# EAGLE schematic Resistor_Resistor (EAGLE 8.3.0), part 5 of 43 (continued)
## Parts (continued)
R6592  10K  RESISTOR_0201  [0201]
R6593  10K  RESISTOR_0201  [0201]
R6594  10K  RESISTOR_0201  [0201]
R6595  10K  RESISTOR_0201  [0201]
R6596  10K  RESISTOR_0201  [0201]
R6597  10K  RESISTOR_0201  [0201]
R6598  10K  RESISTOR_0201  [0201]
R6599  10K  RESISTOR_0201  [0201]
R6600  10K  RESISTOR_0201  [0201]
R6601  10K  RESISTOR_0201  [0201]
R6602  10K  RESISTOR_0201  [0201]
R6603  10K  RESISTOR_0201  [0201]
R6604  10K  RESISTOR_0201  [0201]
R6605  10K  RESISTOR_0201  [0201]
R6606  10K  RESISTOR_0201  [0201]
R6607  10K  RESISTOR_0201  [0201]
R6608  10K  RESISTOR_0201  [0201]
R6609  10K  RESISTOR_0201  [0201]
R6610  10K  RESISTOR_0201  [0201]
R6611  10K  RESISTOR_0201  [0201]
R6612  10K  RESISTOR_0201  [0201]
R6613  10K  RESISTOR_0201  [0201]
R6614  10K  RESISTOR_0201  [0201]
R6615  10K  RESISTOR_0201  [0201]
R6616  10K  RESISTOR_0201  [0201]
R6617  10K  RESISTOR_0201  [0201]
R6618  10K  RESISTOR_0201  [0201]
R6619  10K  RESISTOR_0201  [0201]
R6620  10K  RESISTOR_0201  [0201]
R6621  10K  RESISTOR_0201  [0201]
R6622  10K  RESISTOR_0201  [0201]
R6623  10K  RESISTOR_0201  [0201]
R6624  10K  RESISTOR_0201  [0201]
R6625  10K  RESISTOR_0201  [0201]
R6626  10K  RESISTOR_0201  [0201]
R6627  10K  RESISTOR_0201  [0201]
R6628  10K  RESISTOR_0201  [0201]
R6629  10K  RESISTOR_0201  [0201]
R6630  10K  RESISTOR_0201  [0201]
R6631  10K  RESISTOR_0201  [0201]
R6632  10K  RESISTOR_0201  [0201]
R6633  10K  RESISTOR_0201  [0201]
R6634  10K  RESISTOR_0201  [0201]
R6635  10K  RESISTOR_0201  [0201]
R6636  10K  RESISTOR_0201  [0201]
R6637  10K  RESISTOR_0201  [0201]
R6638  10K  RESISTOR_0201  [0201]
R6639  10K  RESISTOR_0201  [0201]
R6640  10K  RESISTOR_0201  [0201]
R6641  10K  RESISTOR_0201  [0201]
R6642  10K  RESISTOR_0201  [0201]
R6643  10K  RESISTOR_0201  [0201]
R6644  10K  RESISTOR_0201  [0201]
R6645  10K  RESISTOR_0201  [0201]
R6646  10K  RESISTOR_0201  [0201]
R6647  10K  RESISTOR_0201  [0201]
R6648  10K  RESISTOR_0201  [0201]
R6649  10K  RESISTOR_0201  [0201]
R6650  10K  RESISTOR_0201  [0201]
R6651  10K  RESISTOR_0201  [0201]
R6652  10K  RESISTOR_0201  [0201]
R6653  10K  RESISTOR_0201  [0201]
R6654  10K  RESISTOR_0201  [0201]
R6655  10K  RESISTOR_0201  [0201]
R6656  10K  RESISTOR_0201  [0201]
R6657  10K  RESISTOR_0201  [0201]
R6658  10K  RESISTOR_0201  [0201]
R6659  10K  RESISTOR_0201  [0201]
R6660  10K  RESISTOR_0201  [0201]
R6661  10K  RESISTOR_0201  [0201]
R6662  10K  RESISTOR_0201  [0201]
R6663  10K  RESISTOR_0201  [0201]
R6664  10K  RESISTOR_0201  [0201]
R6665  10K  RESISTOR_0201  [0201]
R6666  10K  RESISTOR_0201  [0201]
R6667  10K  RESISTOR_0201  [0201]
R6668  10K  RESISTOR_0201  [0201]
R6669  10K  RESISTOR_0201  [0201]
R6670  10K  RESISTOR_0201  [0201]
R6671  10K  RESISTOR_0201  [0201]
R6672  10K  RESISTOR_0201  [0201]
R6673  10K  RESISTOR_0201  [0201]
R6674  10K  RESISTOR_0201  [0201]
R6675  10K  RESISTOR_0201  [0201]
R6676  10K  RESISTOR_0201  [0201]
R6677  10K  RESISTOR_0201  [0201]
R6678  10K  RESISTOR_0201  [0201]
R6679  10K  RESISTOR_0201  [0201]
R6680  10K  RESISTOR_0201  [0201]
R6681  10K  RESISTOR_0201  [0201]
R6682  10K  RESISTOR_0201  [0201]
R6683  10K  RESISTOR_0201  [0201]
R6684  10K  RESISTOR_0201  [0201]
R6685  10K  RESISTOR_0201  [0201]
R6686  10K  RESISTOR_0201  [0201]
R6687  10K  RESISTOR_0201  [0201]
R6688  10K  RESISTOR_0201  [0201]
R6689  10K  RESISTOR_0201  [0201]
R6690  10K  RESISTOR_0201  [0201]
R6691  10K  RESISTOR_0201  [0201]
R6692  10K  RESISTOR_0201  [0201]
R6693  10K  RESISTOR_0201  [0201]
R6694  10K  RESISTOR_0201  [0201]
R6695  10K  RESISTOR_0201  [0201]
R6696  10K  RESISTOR_0201  [0201]
R6697  10K  RESISTOR_0201  [0201]
R6698  10K  RESISTOR_0201  [0201]
R6699  10K  RESISTOR_0201  [0201]
R6700  10K  RESISTOR_0201  [0201]
R6701  10K  RESISTOR_0201  [0201]
R6702  10K  RESISTOR_0201  [0201]
R6703  10K  RESISTOR_0201  [0201]
R6704  10K  RESISTOR_0201  [0201]
R6705  10K  RESISTOR_0201  [0201]
R6706  10K  RESISTOR_0201  [0201]
R6707  10K  RESISTOR_0201  [0201]
R6708  10K  RESISTOR_0201  [0201]
R6709  10K  RESISTOR_0201  [0201]
R6710  10K  RESISTOR_0201  [0201]
R6711  10K  RESISTOR_0201  [0201]
R6712  10K  RESISTOR_0201  [0201]
R6713  10K  RESISTOR_0201  [0201]
R6714  10K  RESISTOR_0201  [0201]
R6715  10K  RESISTOR_0201  [0201]
R6716  10K  RESISTOR_0201  [0201]
R6717  10K  RESISTOR_0201  [0201]
R6718  10K  RESISTOR_0201  [0201]
R6719  10K  RESISTOR_0201  [0201]
R6720  10K  RESISTOR_0201  [0201]
R6721  10K  RESISTOR_0201  [0201]
R6722  10K  RESISTOR_0201  [0201]
R6723  10K  RESISTOR_0201  [0201]
R6724  10K  RESISTOR_0201  [0201]
R6725  10K  RESISTOR_0201  [0201]
R6726  10K  RESISTOR_0201  [0201]
R6727  10K  RESISTOR_0201  [0201]
R6728  10K  RESISTOR_0201  [0201]
R6729  10K  RESISTOR_0201  [0201]
R6730  10K  RESISTOR_0201  [0201]
R6731  10K  RESISTOR_0201  [0201]
R6732  10K  RESISTOR_0201  [0201]
R6733  10K  RESISTOR_0201  [0201]
R6734  10K  RESISTOR_0201  [0201]
R6735  10K  RESISTOR_0201  [0201]
R6736  10K  RESISTOR_0201  [0201]
R6737  10K  RESISTOR_0201  [0201]
R6738  10K  RESISTOR_0201  [0201]
R6739  10K  RESISTOR_0201  [0201]
R6740  10K  RESISTOR_0201  [0201]
R6741  10K  RESISTOR_0201  [0201]
R6742  10K  RESISTOR_0201  [0201]
R6743  10K  RESISTOR_0201  [0201]
R6744  10K  RESISTOR_0201  [0201]
R6745  10K  RESISTOR_0201  [0201]
R6746  10K  RESISTOR_0201  [0201]
R6747  10K  RESISTOR_0201  [0201]
R6748  10K  RESISTOR_0201  [0201]
R6749  10K  RESISTOR_0201  [0201]
R6750  10K  RESISTOR_0201  [0201]
R6751  10K  RESISTOR_0201  [0201]
R6752  10K  RESISTOR_0201  [0201]
R6753  10K  RESISTOR_0201  [0201]
R6754  10K  RESISTOR_0201  [0201]
R6755  10K  RESISTOR_0201  [0201]
R6756  10K  RESISTOR_0201  [0201]
R6757  10K  RESISTOR_0201  [0201]
R6758  10K  RESISTOR_0201  [0201]
R6759  10K  RESISTOR_0201  [0201]
R6760  10K  RESISTOR_0201  [0201]
R6761  10K  RESISTOR_0201  [0201]
R6762  10K  RESISTOR_0201  [0201]
R6763  10K  RESISTOR_0201  [0201]
R6764  10K  RESISTOR_0201  [0201]
R6765  10K  RESISTOR_0201  [0201]
R6766  10K  RESISTOR_0201  [0201]
R6767  10K  RESISTOR_0201  [0201]
R6768  10K  RESISTOR_0201  [0201]
R6769  10K  RESISTOR_0201  [0201]
R6770  10K  RESISTOR_0201  [0201]
R6771  10K  RESISTOR_0201  [0201]
R6772  10K  RESISTOR_0201  [0201]
R6773  10K  RESISTOR_0201  [0201]
R6774  10K  RESISTOR_0201  [0201]
R6775  10K  RESISTOR_0201  [0201]
R6776  10K  RESISTOR_0201  [0201]
R6777  10K  RESISTOR_0201  [0201]
R6778  10K  RESISTOR_0201  [0201]
R6779  10K  RESISTOR_0201  [0201]
R6780  10K  RESISTOR_0201  [0201]
R6781  10K  RESISTOR_0201  [0201]
R6782  10K  RESISTOR_0201  [0201]
R6783  10K  RESISTOR_0201  [0201]
R6784  10K  RESISTOR_0201  [0201]
R6785  10K  RESISTOR_0201  [0201]
R6786  10K  RESISTOR_0201  [0201]
R6787  10K  RESISTOR_0201  [0201]
R6788  10K  RESISTOR_0201  [0201]
R6789  10K  RESISTOR_0201  [0201]
R6790  10K  RESISTOR_0201  [0201]
R6791  10K  RESISTOR_0201  [0201]
R6792  10K  RESISTOR_0201  [0201]
R6793  10K  RESISTOR_0201  [0201]
R6794  10K  RESISTOR_0201  [0201]
R6795  10K  RESISTOR_0201  [0201]
R6796  10K  RESISTOR_0201  [0201]
R6797  10K  RESISTOR_0201  [0201]
R6798  10K  RESISTOR_0201  [0201]
R6799  10K  RESISTOR_0201  [0201]
R6800  10K  RESISTOR_0201  [0201]
R6801  10K  RESISTOR_0201  [0201]
R6802  10K  RESISTOR_0201  [0201]
R6803  10K  RESISTOR_0201  [0201]
R6804  10K  RESISTOR_0201  [0201]
R6805  10K  RESISTOR_0201  [0201]
R6806  10K  RESISTOR_0201  [0201]
R6807  10K  RESISTOR_0201  [0201]
R6808  10K  RESISTOR_0201  [0201]
R6809  10K  RESISTOR_0201  [0201]
R6810  10K  RESISTOR_0201  [0201]
R6811  10K  RESISTOR_0201  [0201]
R6812  10K  RESISTOR_0201  [0201]
R6813  10K  RESISTOR_0201  [0201]
R6814  10K  RESISTOR_0201  [0201]
R6815  10K  RESISTOR_0201  [0201]
R6816  10K  RESISTOR_0201  [0201]
R6817  10K  RESISTOR_0201  [0201]
R6818  10K  RESISTOR_0201  [0201]
R6819  10K  RESISTOR_0201  [0201]
R6820  10K  RESISTOR_0201  [0201]
R6821  10K  RESISTOR_0201  [0201]
R6822  10K  RESISTOR_0201  [0201]
R6823  10K  RESISTOR_0201  [0201]
R6824  10K  RESISTOR_0201  [0201]
R6825  10K  RESISTOR_0201  [0201]
R6826  10K  RESISTOR_0201  [0201]
R6827  10K  RESISTOR_0201  [0201]
R6828  10K  RESISTOR_0201  [0201]
R6829  10K  RESISTOR_0201  [0201]
R6830  10K  RESISTOR_0201  [0201]
R6831  10K  RESISTOR_0201  [0201]
R6832  10K  RESISTOR_0201  [0201]
R6833  10K  RESISTOR_0201  [0201]
R6834  10K  RESISTOR_0201  [0201]
R6835  10K  RESISTOR_0201  [0201]
R6836  10K  RESISTOR_0201  [0201]
R6837  10K  RESISTOR_0201  [0201]
R6838  10K  RESISTOR_0201  [0201]
R6839  10K  RESISTOR_0201  [0201]
R6840  10K  RESISTOR_0201  [0201]
R6841  10K  RESISTOR_0201  [0201]
R6842  10K  RESISTOR_0201  [0201]
R6843  10K  RESISTOR_0201  [0201]
R6844  10K  RESISTOR_0201  [0201]
R6845  10K  RESISTOR_0201  [0201]
R6846  10K  RESISTOR_0201  [0201]
R6847  10K  RESISTOR_0201  [0201]
R6848  10K  RESISTOR_0201  [0201]
R6849  10K  RESISTOR_0201  [0201]
R6850  10K  RESISTOR_0201  [0201]
R6851  10K  RESISTOR_0201  [0201]
R6852  10K  RESISTOR_0201  [0201]
R6853  10K  RESISTOR_0201  [0201]
R6854  10K  RESISTOR_0201  [0201]
R6855  10K  RESISTOR_0201  [0201]
R6856  10K  RESISTOR_0201  [0201]
R6857  10K  RESISTOR_0201  [0201]
R6858  10K  RESISTOR_0201  [0201]
R6859  10K  RESISTOR_0201  [0201]
R6860  10K  RESISTOR_0201  [0201]
R6861  10K  RESISTOR_0201  [0201]
R6862  10K  RESISTOR_0201  [0201]
R6863  10K  RESISTOR_0201  [0201]
R6864  10K  RESISTOR_0201  [0201]
R6865  10K  RESISTOR_0201  [0201]
R6866  10K  RESISTOR_0201  [0201]
R6867  10K  RESISTOR_0201  [0201]
R6868  10K  RESISTOR_0201  [0201]
R6869  10K  RESISTOR_0201  [0201]
R6870  10K  RESISTOR_0201  [0201]
R6871  10K  RESISTOR_0201  [0201]
R6872  10K  RESISTOR_0201  [0201]
R6873  10K  RESISTOR_0201  [0201]
R6874  10K  RESISTOR_0201  [0201]
R6875  10K  RESISTOR_0201  [0201]
R6876  10K  RESISTOR_0201  [0201]
R6877  10K  RESISTOR_0201  [0201]
R6878  10K  RESISTOR_0201  [0201]
R6879  10K  RESISTOR_0201  [0201]
R6880  10K  RESISTOR_0201  [0201]
R6881  10K  RESISTOR_0201  [0201]
R6882  10K  RESISTOR_0201  [0201]
R6883  10K  RESISTOR_0201  [0201]
R6884  10K  RESISTOR_0201  [0201]
R6885  10K  RESISTOR_0201  [0201]
R6886  10K  RESISTOR_0201  [0201]
R6887  10K  RESISTOR_0201  [0201]
R6888  10K  RESISTOR_0201  [0201]
R6889  10K  RESISTOR_0201  [0201]
R6890  10K  RESISTOR_0201  [0201]
R6891  10K  RESISTOR_0201  [0201]
R6892  10K  RESISTOR_0201  [0201]
R6893  10K  RESISTOR_0201  [0201]
R6894  10K  RESISTOR_0201  [0201]
R6895  10K  RESISTOR_0201  [0201]
R6896  10K  RESISTOR_0201  [0201]
R6897  10K  RESISTOR_0201  [0201]
R6898  10K  RESISTOR_0201  [0201]
R6899  10K  RESISTOR_0201  [0201]
R6900  10K  RESISTOR_0201  [0201]
R6901  10K  RESISTOR_0201  [0201]
R6902  10K  RESISTOR_0201  [0201]
R6903  10K  RESISTOR_0201  [0201]
R6904  10K  RESISTOR_0201  [0201]
R6905  10K  RESISTOR_0201  [0201]
R6906  10K  RESISTOR_0201  [0201]
R6907  10K  RESISTOR_0201  [0201]
R6908  10K  RESISTOR_0201  [0201]
R6909  10K  RESISTOR_0201  [0201]
R6910  10K  RESISTOR_0201  [0201]
R6911  10K  RESISTOR_0201  [0201]
R6912  10K  RESISTOR_0201  [0201]
R6913  10K  RESISTOR_0201  [0201]
R6914  10K  RESISTOR_0201  [0201]
R6915  10K  RESISTOR_0201  [0201]
R6916  10K  RESISTOR_0201  [0201]
R6917  10K  RESISTOR_0201  [0201]
R6918  10K  RESISTOR_0201  [0201]
R6919  10K  RESISTOR_0201  [0201]
R6920  10K  RESISTOR_0201  [0201]
R6921  10K  RESISTOR_0201  [0201]
R6922  10K  RESISTOR_0201  [0201]
R6923  10K  RESISTOR_0201  [0201]
R6924  10K  RESISTOR_0201  [0201]
R6925  10K  RESISTOR_0201  [0201]
R6926  10K  RESISTOR_0201  [0201]
R6927  10K  RESISTOR_0201  [0201]
R6928  10K  RESISTOR_0201  [0201]
R6929  10K  RESISTOR_0201  [0201]
R6930  10K  RESISTOR_0201  [0201]
R6931  10K  RESISTOR_0201  [0201]
R6932  10K  RESISTOR_0201  [0201]
R6933  10K  RESISTOR_0201  [0201]
R6934  10K  RESISTOR_0201  [0201]
R6935  10K  RESISTOR_0201  [0201]
R6936  10K  RESISTOR_0201  [0201]
R6937  10K  RESISTOR_0201  [0201]
R6938  10K  RESISTOR_0201  [0201]
R6939  10K  RESISTOR_0201  [0201]
R6940  10K  RESISTOR_0201  [0201]
R6941  10K  RESISTOR_0201  [0201]
R6942  10K  RESISTOR_0201  [0201]
R6943  10K  RESISTOR_0201  [0201]
R6944  10K  RESISTOR_0201  [0201]
R6945  10K  RESISTOR_0201  [0201]
R6946  10K  RESISTOR_0201  [0201]
R6947  10K  RESISTOR_0201  [0201]
R6948  10K  RESISTOR_0201  [0201]
R6949  10K  RESISTOR_0201  [0201]
R6950  10K  RESISTOR_0201  [0201]
R6951  10K  RESISTOR_0201  [0201]
R6952  10K  RESISTOR_0201  [0201]
R6953  10K  RESISTOR_0201  [0201]
R6954  10K  RESISTOR_0201  [0201]
R6955  10K  RESISTOR_0201  [0201]
R6956  10K  RESISTOR_0201  [0201]
R6957  10K  RESISTOR_0201  [0201]
R6958  10K  RESISTOR_0201  [0201]
R6959  10K  RESISTOR_0201  [0201]
R6960  10K  RESISTOR_0201  [0201]
R6961  10K  RESISTOR_0201  [0201]
R6962  10K  RESISTOR_0201  [0201]
R6963  10K  RESISTOR_0201  [0201]
R6964  10K  RESISTOR_0201  [0201]
R6965  10K  RESISTOR_0201  [0201]
R6966  10K  RESISTOR_0201  [0201]
R6967  10K  RESISTOR_0201  [0201]
R6968  10K  RESISTOR_0201  [0201]
R6969  10K  RESISTOR_0201  [0201]
R6970  10K  RESISTOR_0201  [0201]
R6971  10K  RESISTOR_0201  [0201]
R6972  10K  RESISTOR_0201  [0201]
R6973  10K  RESISTOR_0201  [0201]
R6974  10K  RESISTOR_0201  [0201]
R6975  10K  RESISTOR_0201  [0201]
R6976  10K  RESISTOR_0201  [0201]
R6977  10K  RESISTOR_0201  [0201]
R6978  10K  RESISTOR_0201  [0201]
R6979  10K  RESISTOR_0201  [0201]
R6980  10K  RESISTOR_0201  [0201]
R6981  10K  RESISTOR_0201  [0201]
R6982  10K  RESISTOR_0201  [0201]
R6983  10K  RESISTOR_0201  [0201]
R6984  10K  RESISTOR_0201  [0201]
R6985  10K  RESISTOR_0201  [0201]
R6986  10K  RESISTOR_0201  [0201]
R6987  10K  RESISTOR_0201  [0201]
R6988  10K  RESISTOR_0201  [0201]
R6989  10K  RESISTOR_0201  [0201]
R6990  10K  RESISTOR_0201  [0201]
R6991  10K  RESISTOR_0201  [0201]
R6992  10K  RESISTOR_0201  [0201]
R6993  10K  RESISTOR_0201  [0201]
R6994  10K  RESISTOR_0201  [0201]
R6995  10K  RESISTOR_0201  [0201]
R6996  10K  RESISTOR_0201  [0201]
R6997  10K  RESISTOR_0201  [0201]
R6998  10K  RESISTOR_0201  [0201]
R6999  10K  RESISTOR_0201  [0201]
R7000  10K  RESISTOR_0201  [0201]
R7001  10K  RESISTOR_0201  [0201]
R7002  10K  RESISTOR_0201  [0201]
R7003  10K  RESISTOR_0201  [0201]
R7004  10K  RESISTOR_0201  [0201]
R7005  10K  RESISTOR_0201  [0201]
R7006  10K  RESISTOR_0201  [0201]
R7007  10K  RESISTOR_0201  [0201]
R7008  10K  RESISTOR_0201  [0201]
R7009  10K  RESISTOR_0201  [0201]
R7010  10K  RESISTOR_0201  [0201]
R7011  10K  RESISTOR_0201  [0201]
R7012  10K  RESISTOR_0201  [0201]
R7013  10K  RESISTOR_0201  [0201]
R7014  10K  RESISTOR_0201  [0201]
R7015  10K  RESISTOR_0201  [0201]
R7016  10K  RESISTOR_0201  [0201]
R7017  10K  RESISTOR_0201  [0201]
R7018  10K  RESISTOR_0201  [0201]
R7019  10K  RESISTOR_0201  [0201]
R7020  10K  RESISTOR_0201  [0201]
R7021  10K  RESISTOR_0201  [0201]
R7022  10K  RESISTOR_0201  [0201]
R7023  10K  RESISTOR_0201  [0201]
R7024  10K  RESISTOR_0201  [0201]
R7025  10K  RESISTOR_0201  [0201]
R7026  10K  RESISTOR_0201  [0201]
R7027  10K  RESISTOR_0201  [0201]
R7028  10K  RESISTOR_0201  [0201]
R7029  10K  RESISTOR_0201  [0201]
R7030  10K  RESISTOR_0201  [0201]
R7031  10K  RESISTOR_0201  [0201]
R7032  10K  RESISTOR_0201  [0201]
R7033  10K  RESISTOR_0201  [0201]
R7034  10K  RESISTOR_0201  [0201]
R7035  10K  RESISTOR_0201  [0201]
R7036  10K  RESISTOR_0201  [0201]
R7037  10K  RESISTOR_0201  [0201]
R7038  10K  RESISTOR_0201  [0201]
R7039  10K  RESISTOR_0201  [0201]
R7040  10K  RESISTOR_0201  [0201]
R7041  10K  RESISTOR_0201  [0201]
R7042  10K  RESISTOR_0201  [0201]
R7043  10K  RESISTOR_0201  [0201]
R7044  10K  RESISTOR_0201  [0201]
R7045  10K  RESISTOR_0201  [0201]
R7046  10K  RESISTOR_0201  [0201]
R7047  10K  RESISTOR_0201  [0201]
R7048  10K  RESISTOR_0201  [0201]
R7049  10K  RESISTOR_0201  [0201]
R7050  10K  RESISTOR_0201  [0201]
R7051  10K  RESISTOR_0201  [0201]
R7052  10K  RESISTOR_0201  [0201]
R7053  10K  RESISTOR_0201  [0201]
R7054  10K  RESISTOR_0201  [0201]
R7055  10K  RESISTOR_0201  [0201]
R7056  10K  RESISTOR_0201  [0201]
R7057  10K  RESISTOR_0201  [0201]
R7058  10K  RESISTOR_0201  [0201]
R7059  10K  RESISTOR_0201  [0201]
R7060  10K  RESISTOR_0201  [0201]
R7061  10K  RESISTOR_0201  [0201]
R7062  10K  RESISTOR_0201  [0201]
R7063  10K  RESISTOR_0201  [0201]
R7064  10K  RESISTOR_0201  [0201]
R7065  10K  RESISTOR_0201  [0201]
R7066  10K  RESISTOR_0201  [0201]
R7067  10K  RESISTOR_0201  [0201]
R7068  10K  RESISTOR_0201  [0201]
R7069  10K  RESISTOR_0201  [0201]
R7070  10K  RESISTOR_0201  [0201]
R7071  10K  RESISTOR_0201  [0201]
R7072  10K  RESISTOR_0201  [0201]
R7073  10K  RESISTOR_0201  [0201]
R7074  10K  RESISTOR_0201  [0201]
R7075  10K  RESISTOR_0201  [0201]
R7076  10K  RESISTOR_0201  [0201]
R7077  10K  RESISTOR_0201  [0201]
R7078  10K  RESISTOR_0201  [0201]
R7079  10K  RESISTOR_0201  [0201]
R7080  10K  RESISTOR_0201  [0201]
R7081  10K  RESISTOR_0201  [0201]
R7082  10K  RESISTOR_0201  [0201]
R7083  10K  RESISTOR_0201  [0201]
R7084  10K  RESISTOR_0201  [0201]
R7085  10K  RESISTOR_0201  [0201]
R7086  10K  RESISTOR_0201  [0201]
R7087  10K  RESISTOR_0201  [0201]
R7088  10K  RESISTOR_0201  [0201]
R7089  10K  RESISTOR_0201  [0201]
R7090  10K  RESISTOR_0201  [0201]
R7091  10K  RESISTOR_0201  [0201]
R7092  10K  RESISTOR_0201  [0201]
R7093  10K  RESISTOR_0201  [0201]
R7094  10K  RESISTOR_0201  [0201]
R7095  10K  RESISTOR_0201  [0201]
R7096  10K  RESISTOR_0201  [0201]
R7097  10K  RESISTOR_0201  [0201]
R7098  10K  RESISTOR_0201  [0201]
R7099  10K  RESISTOR_0201  [0201]
R7100  10K  RESISTOR_0201  [0201]
R7101  10K  RESISTOR_0201  [0201]
R7102  10K  RESISTOR_0201  [0201]
R7103  10K  RESISTOR_0201  [0201]
R7104  10K  RESISTOR_0201  [0201]
R7105  10K  RESISTOR_0201  [0201]
R7106  10K  RESISTOR_0201  [0201]
R7107  10K  RESISTOR_0201  [0201]
R7108  10K  RESISTOR_0201  [0201]
R7109  10K  RESISTOR_0201  [0201]
R7110  10K  RESISTOR_0201  [0201]
R7111  10K  RESISTOR_0201  [0201]
R7112  10K  RESISTOR_0201  [0201]
R7113  10K  RESISTOR_0201  [0201]
R7114  10K  RESISTOR_0201  [0201]
R7115  10K  RESISTOR_0201  [0201]
R7116  10K  RESISTOR_0201  [0201]
R7117  10K  RESISTOR_0201  [0201]
R7118  10K  RESISTOR_0201  [0201]
R7119  10K  RESISTOR_0201  [0201]
R7120  10K  RESISTOR_0201  [0201]
R7121  10K  RESISTOR_0201  [0201]
R7122  10K  RESISTOR_0201  [0201]
R7123  10K  RESISTOR_0201  [0201]
R7124  10K  RESISTOR_0201  [0201]
R7125  10K  RESISTOR_0201  [0201]
R7126  10K  RESISTOR_0201  [0201]
R7127  10K  RESISTOR_0201  [0201]
R7128  10K  RESISTOR_0201  [0201]
R7129  10K  RESISTOR_0201  [0201]
R7130  10K  RESISTOR_0201  [0201]
R7131  10K  RESISTOR_0201  [0201]
R7132  10K  RESISTOR_0201  [0201]
R7133  10K  RESISTOR_0201  [0201]
R7134  10K  RESISTOR_0201  [0201]
R7135  10K  RESISTOR_0201  [0201]
R7136  10K  RESISTOR_0201  [0201]
R7137  10K  RESISTOR_0201  [0201]
R7138  10K  RESISTOR_0201  [0201]
R7139  10K  RESISTOR_0201  [0201]
R7140  10K  RESISTOR_0201  [0201]
R7141  10K  RESISTOR_0201  [0201]
R7142  10K  RESISTOR_0201  [0201]
R7143  10K  RESISTOR_0201  [0201]
R7144  10K  RESISTOR_0201  [0201]
R7145  10K  RESISTOR_0201  [0201]
R7146  10K  RESISTOR_0201  [0201]
R7147  10K  RESISTOR_0201  [0201]
R7148  10K  RESISTOR_0201  [0201]
R7149  10K  RESISTOR_0201  [0201]
R7150  10K  RESISTOR_0201  [0201]
R7151  10K  RESISTOR_0201  [0201]
R7152  10K  RESISTOR_0201  [0201]
R7153  10K  RESISTOR_0201  [0201]
R7154  10K  RESISTOR_0201  [0201]
R7155  10K  RESISTOR_0201  [0201]
R7156  10K  RESISTOR_0201  [0201]
R7157  10K  RESISTOR_0201  [0201]
R7158  10K  RESISTOR_0201  [0201]
R7159  10K  RESISTOR_0201  [0201]
R7160  10K  RESISTOR_0201  [0201]
R7161  10K  RESISTOR_0201  [0201]
R7162  10K  RESISTOR_0201  [0201]
R7163  10K  RESISTOR_0201  [0201]
R7164  10K  RESISTOR_0201  [0201]
R7165  10K  RESISTOR_0201  [0201]
R7166  10K  RESISTOR_0201  [0201]
R7167  10K  RESISTOR_0201  [0201]
R7168  10K  RESISTOR_0201  [0201]
R7169  10K  RESISTOR_0201  [0201]
R7170  10K  RESISTOR_0201  [0201]
R7171  10K  RESISTOR_0201  [0201]
R7172  10K  RESISTOR_0201  [0201]
R7173  10K  RESISTOR_0201  [0201]
R7174  10K  RESISTOR_0201  [0201]
R7175  10K  RESISTOR_0201  [0201]
R7176  10K  RESISTOR_0201  [0201]
R7177  10K  RESISTOR_0201  [0201]
R7178  10K  RESISTOR_0201  [0201]
R7179  10K  RESISTOR_0201  [0201]
R7180  10K  RESISTOR_0201  [0201]
R7181  10K  RESISTOR_0201  [0201]
R7182  10K  RESISTOR_0201  [0201]
R7183  10K  RESISTOR_0201  [0201]
R7184  10K  RESISTOR_0201  [0201]
R7185  10K  RESISTOR_0201  [0201]
R7186  10K  RESISTOR_0201  [0201]
R7187  10K  RESISTOR_0201  [0201]
R7188  10K  RESISTOR_0201  [0201]
R7189  10K  RESISTOR_0201  [0201]
R7190  10K  RESISTOR_0201  [0201]
R7191  10K  RESISTOR_0201  [0201]
R7192  10K  RESISTOR_0201  [0201]
R7193  10K  RESISTOR_0201  [0201]
R7194  10K  RESISTOR_0201  [0201]
R7195  10K  RESISTOR_0201  [0201]
R7196  10K  RESISTOR_0201  [0201]
R7197  10K  RESISTOR_0201  [0201]
R7198  10K  RESISTOR_0201  [0201]
R7199  10K  RESISTOR_0201  [0201]
R7200  10K  RESISTOR_0201  [0201]
R7201  10K  RESISTOR_0201  [0201]
R7202  10K  RESISTOR_0201  [0201]
R7203  10K  RESISTOR_0201  [0201]
R7204  10K  RESISTOR_0201  [0201]
R7205  10K  RESISTOR_0201  [0201]
R7206  10K  RESISTOR_0201  [0201]
R7207  10K  RESISTOR_0201  [0201]
R7208  10K  RESISTOR_0201  [0201]
R7209  10K  RESISTOR_0201  [0201]
R7210  10K  RESISTOR_0201  [0201]
R7211  10K  RESISTOR_0201  [0201]
R7212  10K  RESISTOR_0201  [0201]
R7213  10K  RESISTOR_0201  [0201]
R7214  10K  RESISTOR_0201  [0201]
R7215  10K  RESISTOR_0201  [0201]
R7216  10K  RESISTOR_0201  [0201]
R7217  10K  RESISTOR_0201  [0201]
R7218  10K  RESISTOR_0201  [0201]
R7219  10K  RESISTOR_0201  [0201]
R7220  10K  RESISTOR_0201  [0201]
R7221  10K  RESISTOR_0201  [0201]
R7222  10K  RESISTOR_0201  [0201]
R7223  10K  RESISTOR_0201  [0201]
R7224  10K  RESISTOR_0201  [0201]
R7225  10K  RESISTOR_0201  [0201]
R7226  10K  RESISTOR_0201  [0201]
R7227  10K  RESISTOR_0201  [0201]
R7228  10K  RESISTOR_0201  [0201]
R7229  10K  RESISTOR_0201  [0201]
R7230  10K  RESISTOR_0201  [0201]
R7231  10K  RESISTOR_0201  [0201]
R7232  10K  RESISTOR_0201  [0201]
R7233  10K  RESISTOR_0201  [0201]
R7234  10K  RESISTOR_0201  [0201]
R7235  10K  RESISTOR_0201  [0201]
R7236  10K  RESISTOR_0201  [0201]
R7237  10K  RESISTOR_0201  [0201]
R7238  10K  RESISTOR_0201  [0201]
R7239  10K  RESISTOR_0201  [0201]
R7240  10K  RESISTOR_0201  [0201]
R7241  10K  RESISTOR_0201  [0201]
R7242  10K  RESISTOR_0201  [0201]
R7243  10K  RESISTOR_0201  [0201]
R7244  10K  RESISTOR_0201  [0201]
R7245  10K  RESISTOR_0201  [0201]
R7246  10K  RESISTOR_0201  [0201]
R7247  10K  RESISTOR_0201  [0201]
R7248  10K  RESISTOR_0201  [0201]
R7249  10K  RESISTOR_0201  [0201]
R7250  10K  RESISTOR_0201  [0201]
R7251  10K  RESISTOR_0201  [0201]
R7252  10K  RESISTOR_0201  [0201]
R7253  10K  RESISTOR_0201  [0201]
R7254  10K  RESISTOR_0201  [0201]
R7255  10K  RESISTOR_0201  [0201]
R7256  10K  RESISTOR_0201  [0201]
R7257  10K  RESISTOR_0201  [0201]
R7258  10K  RESISTOR_0201  [0201]
R7259  10K  RESISTOR_0201  [0201]
R7260  10K  RESISTOR_0201  [0201]
R7261  10K  RESISTOR_0201  [0201]
R7262  10K  RESISTOR_0201  [0201]
R7263  10K  RESISTOR_0201  [0201]
R7264  10K  RESISTOR_0201  [0201]
R7265  10K  RESISTOR_0201  [0201]
R7266  10K  RESISTOR_0201  [0201]
R7267  10K  RESISTOR_0201  [0201]
R7268  10K  RESISTOR_0201  [0201]
R7269  10K  RESISTOR_0201  [0201]
R7270  10K  RESISTOR_0201  [0201]
R7271  10K  RESISTOR_0201  [0201]
R7272  10K  RESISTOR_0201  [0201]
R7273  10K  RESISTOR_0201  [0201]
R7274  10K  RESISTOR_0201  [0201]
R7275  10K  RESISTOR_0201  [0201]
R7276  10K  RESISTOR_0201  [0201]
R7277  10K  RESISTOR_0201  [0201]
R7278  10K  RESISTOR_0201  [0201]
R7279  10K  RESISTOR_0201  [0201]
R7280  10K  RESISTOR_0201  [0201]
R7281  10K  RESISTOR_0201  [0201]
R7282  10K  RESISTOR_0201  [0201]
R7283  10K  RESISTOR_0201  [0201]
R7284  10K  RESISTOR_0201  [0201]
R7285  10K  RESISTOR_0201  [0201]
R7286  10K  RESISTOR_0201  [0201]
R7287  10K  RESISTOR_0201  [0201]
R7288  10K  RESISTOR_0201  [0201]
R7289  10K  RESISTOR_0201  [0201]
R7290  10K  RESISTOR_0201  [0201]
R7291  10K  RESISTOR_0201  [0201]
R7292  10K  RESISTOR_0201  [0201]
R7293  10K  RESISTOR_0201  [0201]
R7294  10K  RESISTOR_0201  [0201]
R7295  10K  RESISTOR_0201  [0201]
R7296  10K  RESISTOR_0201  [0201]
R7297  10K  RESISTOR_0201  [0201]
R7298  10K  RESISTOR_0201  [0201]
R7299  10K  RESISTOR_0201  [0201]
R7300  10K  RESISTOR_0201  [0201]
R7301  10K  RESISTOR_0201  [0201]
R7302  10K  RESISTOR_0201  [0201]
R7303  10K  RESISTOR_0201  [0201]
R7304  10K  RESISTOR_0201  [0201]
R7305  10K  RESISTOR_0201  [0201]
R7306  10K  RESISTOR_0201  [0201]
R7307  10K  RESISTOR_0201  [0201]
R7308  10K  RESISTOR_0201  [0201]
R7309  10K  RESISTOR_0201  [0201]
R7310  10K  RESISTOR_0201  [0201]
R7311  10K  RESISTOR_0201  [0201]
R7312  10K  RESISTOR_0201  [0201]
R7313  10K  RESISTOR_0201  [0201]
R7314  10K  RESISTOR_0201  [0201]
R7315  10K  RESISTOR_0201  [0201]
R7316  10K  RESISTOR_0201  [0201]
R7317  10K  RESISTOR_0201  [0201]
R7318  10K  RESISTOR_0201  [0201]
R7319  10K  RESISTOR_0201  [0201]
R7320  10K  RESISTOR_0201  [0201]
R7321  10K  RESISTOR_0201  [0201]
R7322  10K  RESISTOR_0201  [0201]